# EasyEDA Pro project MSDRV3.eprj, schematic Schematic1
Create Date: 2024-11-12; Page Name: P1; Project Name: MSDRV3; Schematic Name: Schematic1; Update Date: 2024-11-12; Company: EasyEDA.com; Drawn: EasyEDA; Page Size: A4; Part Number: JLCPCB-002; Reviewed: EasyEDA; Version: V0.1
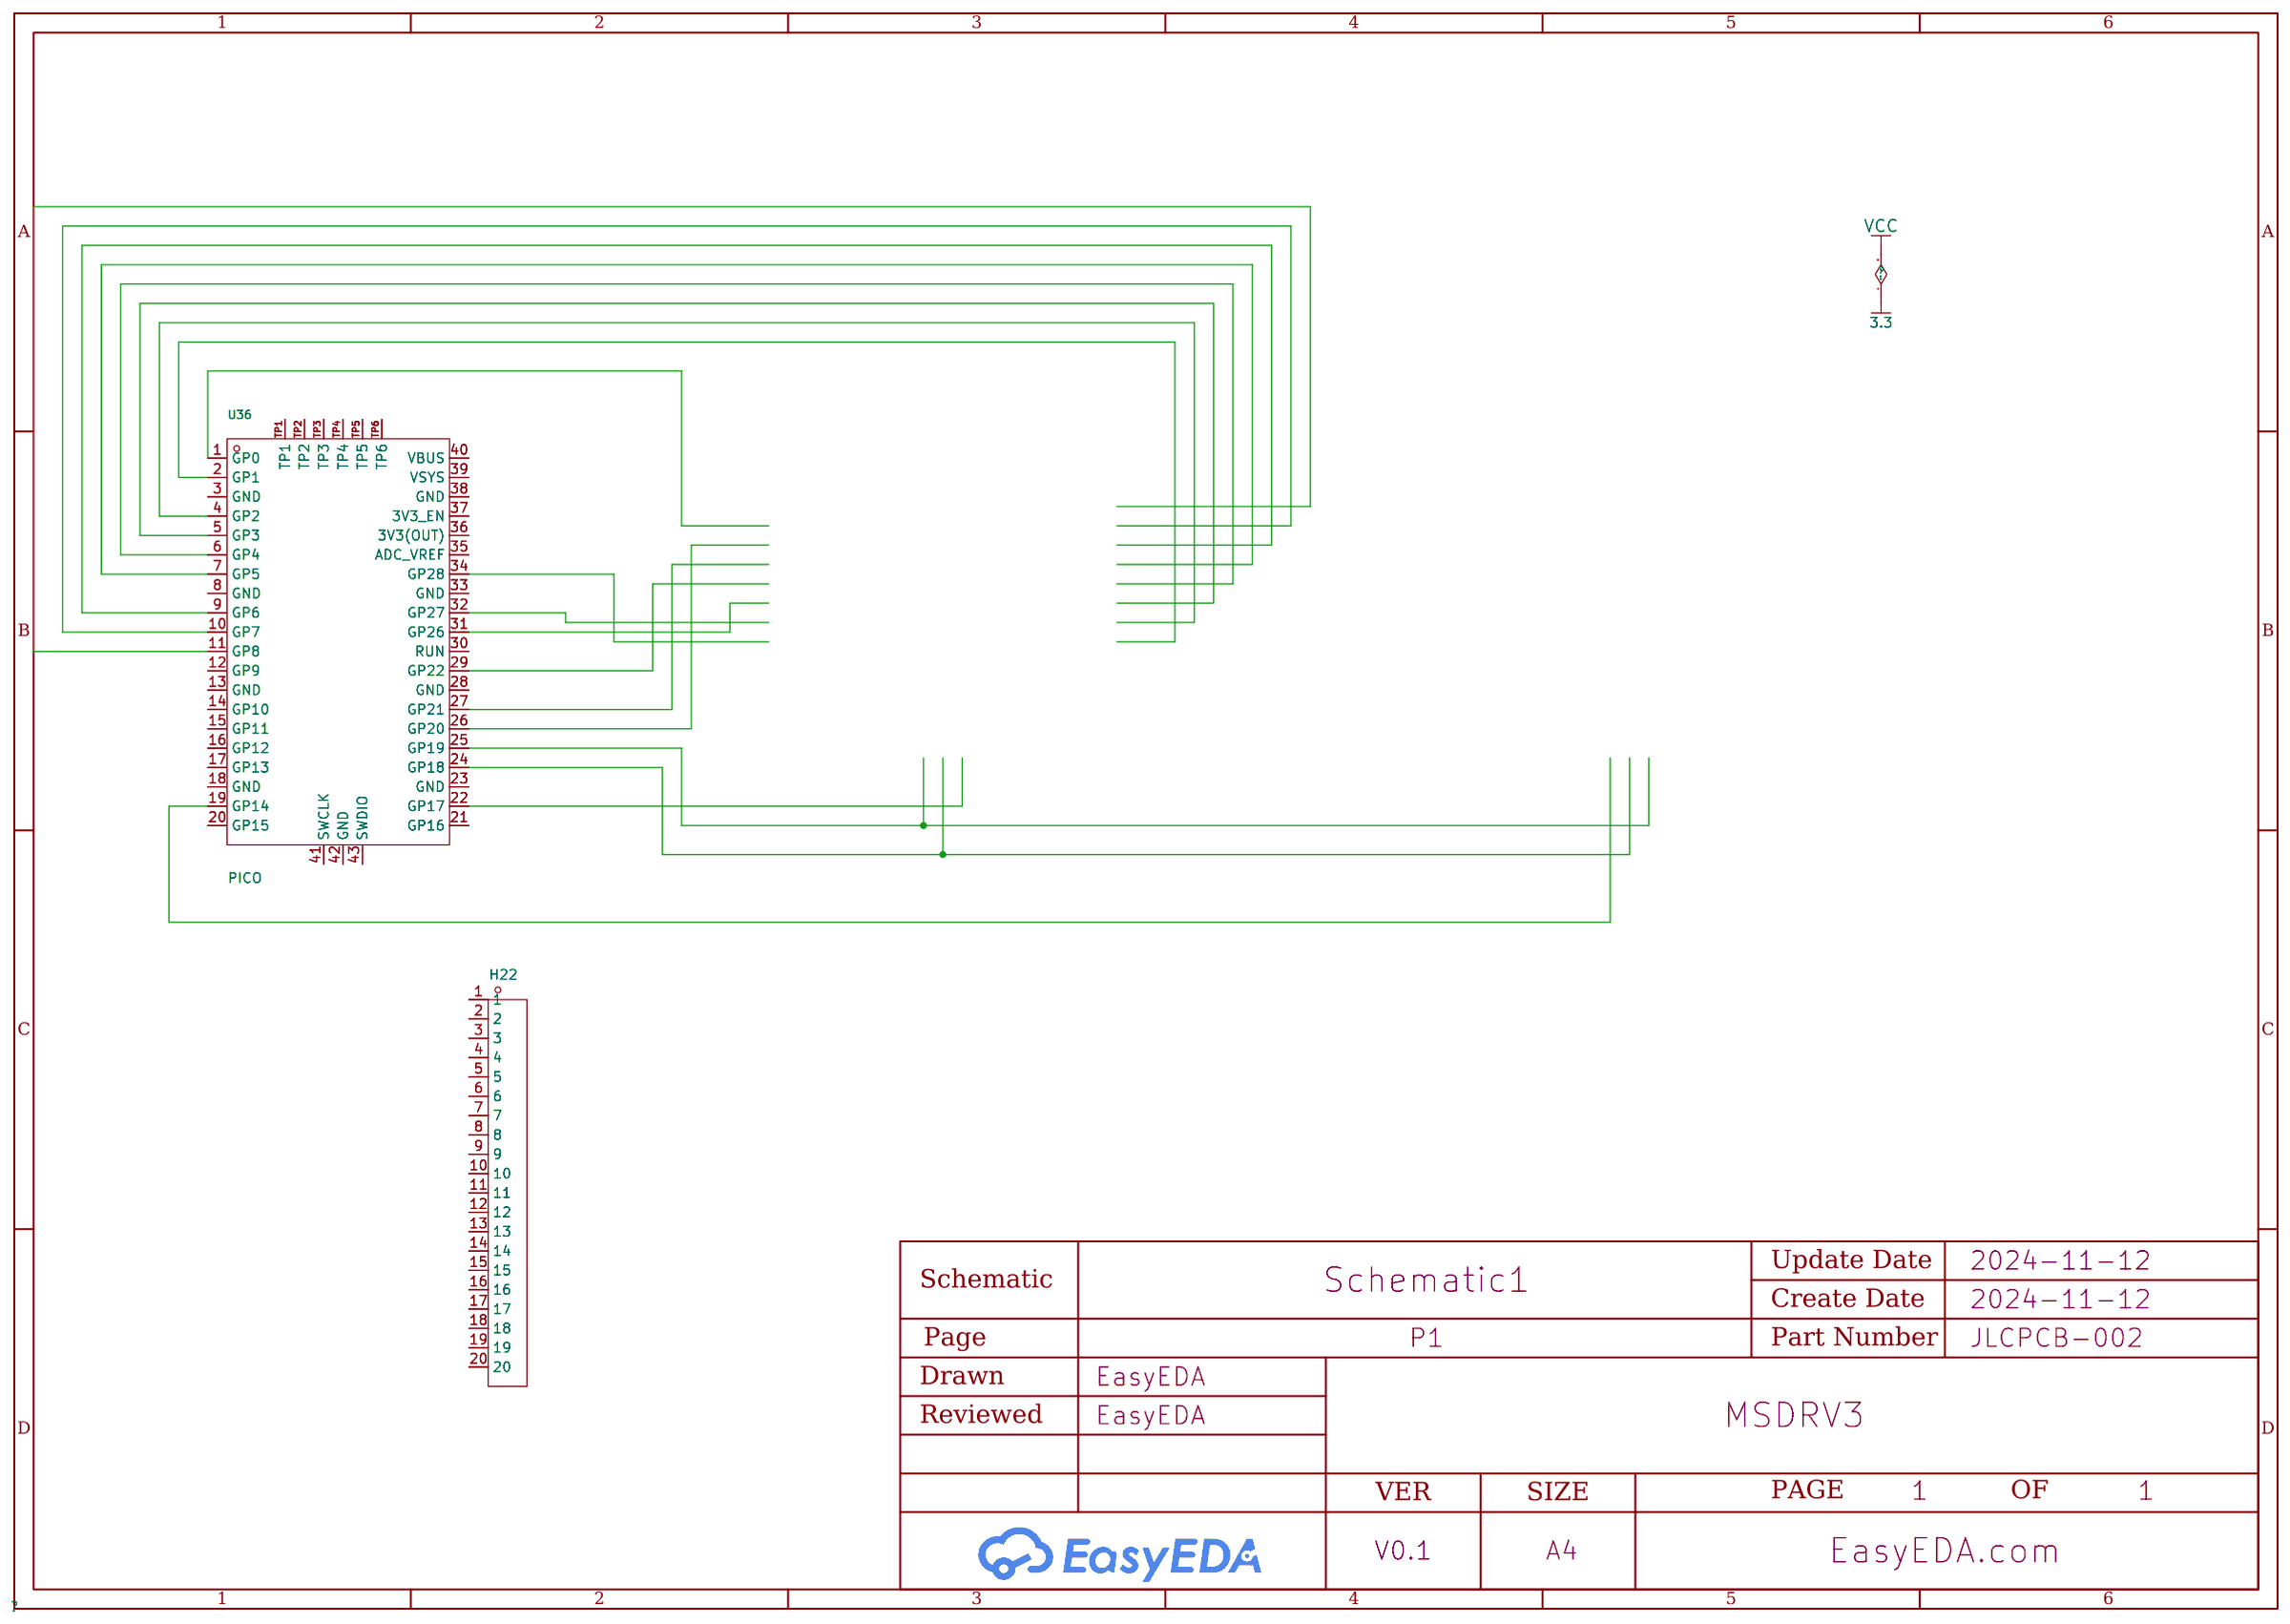
[diagram p0: schematic sheet]

## Parts
CBB1  -
CBB2  -
H22  -  [HDR-TH_20P-P2.54-V-M-1]
U36  PICO  [COMM-SMD_L51.0-W21.0-P2.54_SC0916]

## Library data of the parts
H22 = HDR-M_2.54_1x20P: Supplier Footprint: Through
U36 = PICO: Supplier Part: C7203002; Manufacturer: Raspberry Pi(树莓派); JLCPCB Part Class: Extended Part; Datasheet: https://atta.szlcsc.com/upload/public/pdf/source/20230906/086376002DDC9866828648BC93E51F8B.pdf; Supplier: LCSC; PinNumber: U36(41,42,43,TP1,TP2,TP3,TP4,TP5,TP6)

## Nets
Net-(CBB1-): CBB1.(RXQN) CBB2.(BBC_DA7) U36.1(GP0) U36.2(GP1) U36.4(GP2) U36.5(GP3) U36.6(GP4) U36.7(GP5) U36.9(GP6) U36.10(GP7) U36.11(GP8) U36.19(GP14) U36.22(GP17) U36.24(GP18) U36.25(GP19) U36.26(GP20) U36.27(GP21) U36.29(GP22) U36.31(GP26) U36.32(GP27) U36.34(GP28)

Not connected (* = marked no-connect by the designer): H22 1 2 3 4 5 6 7 8 9 10 11 12 13 14 15 16 17 18 19 20; U36 3(GND) 8(GND) 12(GP9) 13(GND) 14(GP10) 15(GP11) 16(GP12) 17(GP13) 18(GND) 20(GP15) 21(GP16) 23(GND) 28(GND) 30(RUN) 33(GND) 35(ADC_VREF) 36(3V3(OUT)) 37(3V3_EN) 38(GND) 39(VSYS) 40(VBUS) 41(SWCLK) 42(GND) 43(SWDIO) TP1 TP2 TP3 TP4 TP5 TP6
